# EAGLE board Resistor_Resistor (EAGLE 8.3.0), part 19 of 32
## Placement (x,y rotation side) (continued)
R22977  10K  [0201]  164.34,108.56 0 top
R22978  10K  [0201]  164.34,109.17 0 top
R22979  10K  [0201]  164.34,109.78 0 top
R22980  10K  [0201]  164.34,110.39 0 top
R22981  10K  [0201]  164.34,111 0 top
R22982  10K  [0201]  164.34,111.61 0 top
R22983  10K  [0201]  164.34,112.22 0 top
R22984  10K  [0201]  164.34,112.83 0 top
R22985  10K  [0201]  164.34,113.44 0 top
R22986  10K  [0201]  164.34,114.05 0 top
R22987  10K  [0201]  164.34,114.66 0 top
R22988  10K  [0201]  164.34,115.27 0 top
R22989  10K  [0201]  164.34,115.87 0 top
R22990  10K  [0201]  164.34,116.48 0 top
R22991  10K  [0201]  164.34,117.09 0 top
R22992  10K  [0201]  164.34,117.7 0 top
R22993  10K  [0201]  164.34,118.31 0 top
R22994  10K  [0201]  164.34,118.92 0 top
R22995  10K  [0201]  164.34,119.53 0 top
R22996  10K  [0201]  164.34,120.14 0 top
R22997  10K  [0201]  164.34,120.75 0 top
R22998  10K  [0201]  164.34,121.36 0 top
R22999  10K  [0201]  164.34,121.97 0 top
R23000  10K  [0201]  164.34,122.58 0 top
R23001  10K  [0201]  165.56,1.27 0 top
R23002  10K  [0201]  165.56,1.88 0 top
R23003  10K  [0201]  165.56,2.49 0 top
R23004  10K  [0201]  165.56,3.1 0 top
R23005  10K  [0201]  165.56,3.71 0 top
R23006  10K  [0201]  165.56,4.32 0 top
R23007  10K  [0201]  165.56,4.93 0 top
R23008  10K  [0201]  165.56,5.54 0 top
R23009  10K  [0201]  165.56,6.15 0 top
R23010  10K  [0201]  165.56,6.76 0 top
R23011  10K  [0201]  165.56,7.37 0 top
R23012  10K  [0201]  165.56,7.98 0 top
R23013  10K  [0201]  165.56,8.59 0 top
R23014  10K  [0201]  165.56,9.19 0 top
R23015  10K  [0201]  165.56,9.8 0 top
R23016  10K  [0201]  165.56,10.41 0 top
R23017  10K  [0201]  165.56,11.02 0 top
R23018  10K  [0201]  165.56,11.63 0 top
R23019  10K  [0201]  165.56,12.24 0 top
R23020  10K  [0201]  165.56,12.85 0 top
R23021  10K  [0201]  165.56,13.46 0 top
R23022  10K  [0201]  165.56,14.07 0 top
R23023  10K  [0201]  165.56,14.68 0 top
R23024  10K  [0201]  165.56,15.29 0 top
R23025  10K  [0201]  165.56,15.9 0 top
R23026  10K  [0201]  165.56,16.51 0 top
R23027  10K  [0201]  165.56,17.12 0 top
R23028  10K  [0201]  165.56,17.73 0 top
R23029  10K  [0201]  165.56,18.34 0 top
R23030  10K  [0201]  165.56,18.95 0 top
R23031  10K  [0201]  165.56,19.56 0 top
R23032  10K  [0201]  165.56,20.17 0 top
R23033  10K  [0201]  165.56,20.78 0 top
R23034  10K  [0201]  165.56,21.39 0 top
R23035  10K  [0201]  165.56,22 0 top
R23036  10K  [0201]  165.56,22.61 0 top
R23037  10K  [0201]  165.56,23.22 0 top
R23038  10K  [0201]  165.56,23.83 0 top
R23039  10K  [0201]  165.56,24.43 0 top
R23040  10K  [0201]  165.56,25.04 0 top
R23041  10K  [0201]  165.56,25.65 0 top
R23042  10K  [0201]  165.56,26.26 0 top
R23043  10K  [0201]  165.56,26.87 0 top
R23044  10K  [0201]  165.56,27.48 0 top
R23045  10K  [0201]  165.56,28.09 0 top
R23046  10K  [0201]  165.56,28.7 0 top
R23047  10K  [0201]  165.56,29.31 0 top
R23048  10K  [0201]  165.56,29.92 0 top
R23049  10K  [0201]  165.56,30.53 0 top
R23050  10K  [0201]  165.56,31.14 0 top
R23051  10K  [0201]  165.56,31.75 0 top
R23052  10K  [0201]  165.56,32.36 0 top
R23053  10K  [0201]  165.56,32.97 0 top
R23054  10K  [0201]  165.56,33.58 0 top
R23055  10K  [0201]  165.56,34.19 0 top
R23056  10K  [0201]  165.56,34.8 0 top
R23057  10K  [0201]  165.56,35.41 0 top
R23058  10K  [0201]  165.56,36.02 0 top
R23059  10K  [0201]  165.56,36.63 0 top
R23060  10K  [0201]  165.56,37.24 0 top
R23061  10K  [0201]  165.56,37.85 0 top
R23062  10K  [0201]  165.56,38.46 0 top
R23063  10K  [0201]  165.56,39.07 0 top
R23064  10K  [0201]  165.56,39.67 0 top
R23065  10K  [0201]  165.56,40.28 0 top
R23066  10K  [0201]  165.56,40.89 0 top
R23067  10K  [0201]  165.56,41.5 0 top
R23068  10K  [0201]  165.56,42.11 0 top
R23069  10K  [0201]  165.56,42.72 0 top
R23070  10K  [0201]  165.56,43.33 0 top
R23071  10K  [0201]  165.56,43.94 0 top
R23072  10K  [0201]  165.56,44.55 0 top
R23073  10K  [0201]  165.56,45.16 0 top
R23074  10K  [0201]  165.56,45.77 0 top
R23075  10K  [0201]  165.56,46.38 0 top
R23076  10K  [0201]  165.56,46.99 0 top
R23077  10K  [0201]  165.56,47.6 0 top
R23078  10K  [0201]  165.56,48.21 0 top
R23079  10K  [0201]  165.56,48.82 0 top
R23080  10K  [0201]  165.56,49.43 0 top
R23081  10K  [0201]  165.56,50.04 0 top
R23082  10K  [0201]  165.56,50.65 0 top
R23083  10K  [0201]  165.56,51.26 0 top
R23084  10K  [0201]  165.56,51.87 0 top
R23085  10K  [0201]  165.56,52.48 0 top
R23086  10K  [0201]  165.56,53.09 0 top
R23087  10K  [0201]  165.56,53.7 0 top
R23088  10K  [0201]  165.56,54.31 0 top
R23089  10K  [0201]  165.56,54.91 0 top
R23090  10K  [0201]  165.56,55.52 0 top
R23091  10K  [0201]  165.56,56.13 0 top
R23092  10K  [0201]  165.56,56.74 0 top
R23093  10K  [0201]  165.56,57.35 0 top
R23094  10K  [0201]  165.56,57.96 0 top
R23095  10K  [0201]  165.56,58.57 0 top
R23096  10K  [0201]  165.56,59.18 0 top
R23097  10K  [0201]  165.56,59.79 0 top
R23098  10K  [0201]  165.56,60.4 0 top
R23099  10K  [0201]  165.56,61.01 0 top
R23100  10K  [0201]  165.56,61.62 0 top
R23101  10K  [0201]  165.56,62.23 0 top
R23102  10K  [0201]  165.56,62.84 0 top
R23103  10K  [0201]  165.56,63.45 0 top
R23104  10K  [0201]  165.56,64.06 0 top
R23105  10K  [0201]  165.56,64.67 0 top
R23106  10K  [0201]  165.56,65.28 0 top
R23107  10K  [0201]  165.56,65.89 0 top
R23108  10K  [0201]  165.56,66.5 0 top
R23109  10K  [0201]  165.56,67.11 0 top
R23110  10K  [0201]  165.56,67.72 0 top
R23111  10K  [0201]  165.56,68.33 0 top
R23112  10K  [0201]  165.56,68.94 0 top
R23113  10K  [0201]  165.56,69.55 0 top
R23114  10K  [0201]  165.56,70.15 0 top
R23115  10K  [0201]  165.56,70.76 0 top
R23116  10K  [0201]  165.56,71.37 0 top
R23117  10K  [0201]  165.56,71.98 0 top
R23118  10K  [0201]  165.56,72.59 0 top
R23119  10K  [0201]  165.56,73.2 0 top
R23120  10K  [0201]  165.56,73.81 0 top
R23121  10K  [0201]  165.56,74.42 0 top
R23122  10K  [0201]  165.56,75.03 0 top
R23123  10K  [0201]  165.56,75.64 0 top
R23124  10K  [0201]  165.56,76.25 0 top
R23125  10K  [0201]  165.56,76.86 0 top
R23126  10K  [0201]  165.56,77.47 0 top
R23127  10K  [0201]  165.56,78.08 0 top
R23128  10K  [0201]  165.56,78.69 0 top
R23129  10K  [0201]  165.56,79.3 0 top
R23130  10K  [0201]  165.56,79.91 0 top
R23131  10K  [0201]  165.56,80.52 0 top
R23132  10K  [0201]  165.56,81.13 0 top
R23133  10K  [0201]  165.56,81.74 0 top
R23134  10K  [0201]  165.56,82.35 0 top
R23135  10K  [0201]  165.56,82.96 0 top
R23136  10K  [0201]  165.56,83.57 0 top
R23137  10K  [0201]  165.56,84.18 0 top
R23138  10K  [0201]  165.56,84.79 0 top
R23139  10K  [0201]  165.56,85.39 0 top
R23140  10K  [0201]  165.56,86 0 top
R23141  10K  [0201]  165.56,86.61 0 top
R23142  10K  [0201]  165.56,87.22 0 top
R23143  10K  [0201]  165.56,87.83 0 top
R23144  10K  [0201]  165.56,88.44 0 top
R23145  10K  [0201]  165.56,89.05 0 top
R23146  10K  [0201]  165.56,89.66 0 top
R23147  10K  [0201]  165.56,90.27 0 top
R23148  10K  [0201]  165.56,90.88 0 top
R23149  10K  [0201]  165.56,91.49 0 top
R23150  10K  [0201]  165.56,92.1 0 top
R23151  10K  [0201]  165.56,92.71 0 top
R23152  10K  [0201]  165.56,93.32 0 top
R23153  10K  [0201]  165.56,93.93 0 top
R23154  10K  [0201]  165.56,94.54 0 top
R23155  10K  [0201]  165.56,95.15 0 top
R23156  10K  [0201]  165.56,95.76 0 top
R23157  10K  [0201]  165.56,96.37 0 top
R23158  10K  [0201]  165.56,96.98 0 top
R23159  10K  [0201]  165.56,97.59 0 top
R23160  10K  [0201]  165.56,98.2 0 top
R23161  10K  [0201]  165.56,98.81 0 top
R23162  10K  [0201]  165.56,99.42 0 top
R23163  10K  [0201]  165.56,100.03 0 top
R23164  10K  [0201]  165.56,100.63 0 top
R23165  10K  [0201]  165.56,101.24 0 top
R23166  10K  [0201]  165.56,101.85 0 top
R23167  10K  [0201]  165.56,102.46 0 top
R23168  10K  [0201]  165.56,103.07 0 top
R23169  10K  [0201]  165.56,103.68 0 top
R23170  10K  [0201]  165.56,104.29 0 top
R23171  10K  [0201]  165.56,104.9 0 top
R23172  10K  [0201]  165.56,105.51 0 top
R23173  10K  [0201]  165.56,106.12 0 top
R23174  10K  [0201]  165.56,106.73 0 top
R23175  10K  [0201]  165.56,107.34 0 top
R23176  10K  [0201]  165.56,107.95 0 top
R23177  10K  [0201]  165.56,108.56 0 top
R23178  10K  [0201]  165.56,109.17 0 top
R23179  10K  [0201]  165.56,109.78 0 top
R23180  10K  [0201]  165.56,110.39 0 top
R23181  10K  [0201]  165.56,111 0 top
R23182  10K  [0201]  165.56,111.61 0 top
R23183  10K  [0201]  165.56,112.22 0 top
R23184  10K  [0201]  165.56,112.83 0 top
R23185  10K  [0201]  165.56,113.44 0 top
R23186  10K  [0201]  165.56,114.05 0 top
R23187  10K  [0201]  165.56,114.66 0 top
R23188  10K  [0201]  165.56,115.27 0 top
R23189  10K  [0201]  165.56,115.87 0 top
R23190  10K  [0201]  165.56,116.48 0 top
R23191  10K  [0201]  165.56,117.09 0 top
R23192  10K  [0201]  165.56,117.7 0 top
R23193  10K  [0201]  165.56,118.31 0 top
R23194  10K  [0201]  165.56,118.92 0 top
R23195  10K  [0201]  165.56,119.53 0 top
R23196  10K  [0201]  165.56,120.14 0 top
R23197  10K  [0201]  165.56,120.75 0 top
R23198  10K  [0201]  165.56,121.36 0 top
R23199  10K  [0201]  165.56,121.97 0 top
R23200  10K  [0201]  165.56,122.58 0 top
R23201  10K  [0201]  166.78,1.27 0 top
R23202  10K  [0201]  166.78,1.88 0 top
R23203  10K  [0201]  166.78,2.49 0 top
R23204  10K  [0201]  166.78,3.1 0 top
R23205  10K  [0201]  166.78,3.71 0 top
R23206  10K  [0201]  166.78,4.32 0 top
R23207  10K  [0201]  166.78,4.93 0 top
R23208  10K  [0201]  166.78,5.54 0 top
R23209  10K  [0201]  166.78,6.15 0 top
R23210  10K  [0201]  166.78,6.76 0 top
R23211  10K  [0201]  166.78,7.37 0 top
R23212  10K  [0201]  166.78,7.98 0 top
R23213  10K  [0201]  166.78,8.59 0 top
R23214  10K  [0201]  166.78,9.19 0 top
R23215  10K  [0201]  166.78,9.8 0 top
R23216  10K  [0201]  166.78,10.41 0 top
R23217  10K  [0201]  166.78,11.02 0 top
R23218  10K  [0201]  166.78,11.63 0 top
R23219  10K  [0201]  166.78,12.24 0 top
R23220  10K  [0201]  166.78,12.85 0 top
R23221  10K  [0201]  166.78,13.46 0 top
R23222  10K  [0201]  166.78,14.07 0 top
R23223  10K  [0201]  166.78,14.68 0 top
R23224  10K  [0201]  166.78,15.29 0 top
R23225  10K  [0201]  166.78,15.9 0 top
R23226  10K  [0201]  166.78,16.51 0 top
R23227  10K  [0201]  166.78,17.12 0 top
R23228  10K  [0201]  166.78,17.73 0 top
R23229  10K  [0201]  166.78,18.34 0 top
R23230  10K  [0201]  166.78,18.95 0 top
R23231  10K  [0201]  166.78,19.56 0 top
R23232  10K  [0201]  166.78,20.17 0 top
R23233  10K  [0201]  166.78,20.78 0 top
R23234  10K  [0201]  166.78,21.39 0 top
R23235  10K  [0201]  166.78,22 0 top
R23236  10K  [0201]  166.78,22.61 0 top
R23237  10K  [0201]  166.78,23.22 0 top
R23238  10K  [0201]  166.78,23.83 0 top
R23239  10K  [0201]  166.78,24.43 0 top
R23240  10K  [0201]  166.78,25.04 0 top
R23241  10K  [0201]  166.78,25.65 0 top
R23242  10K  [0201]  166.78,26.26 0 top
R23243  10K  [0201]  166.78,26.87 0 top
R23244  10K  [0201]  166.78,27.48 0 top
R23245  10K  [0201]  166.78,28.09 0 top
R23246  10K  [0201]  166.78,28.7 0 top
R23247  10K  [0201]  166.78,29.31 0 top
R23248  10K  [0201]  166.78,29.92 0 top
R23249  10K  [0201]  166.78,30.53 0 top
R23250  10K  [0201]  166.78,31.14 0 top
R23251  10K  [0201]  166.78,31.75 0 top
R23252  10K  [0201]  166.78,32.36 0 top
R23253  10K  [0201]  166.78,32.97 0 top
R23254  10K  [0201]  166.78,33.58 0 top
R23255  10K  [0201]  166.78,34.19 0 top
R23256  10K  [0201]  166.78,34.8 0 top
R23257  10K  [0201]  166.78,35.41 0 top
R23258  10K  [0201]  166.78,36.02 0 top
R23259  10K  [0201]  166.78,36.63 0 top
R23260  10K  [0201]  166.78,37.24 0 top
R23261  10K  [0201]  166.78,37.85 0 top
R23262  10K  [0201]  166.78,38.46 0 top
R23263  10K  [0201]  166.78,39.07 0 top
R23264  10K  [0201]  166.78,39.67 0 top
R23265  10K  [0201]  166.78,40.28 0 top
R23266  10K  [0201]  166.78,40.89 0 top
R23267  10K  [0201]  166.78,41.5 0 top
R23268  10K  [0201]  166.78,42.11 0 top
R23269  10K  [0201]  166.78,42.72 0 top
R23270  10K  [0201]  166.78,43.33 0 top
R23271  10K  [0201]  166.78,43.94 0 top
R23272  10K  [0201]  166.78,44.55 0 top
R23273  10K  [0201]  166.78,45.16 0 top
R23274  10K  [0201]  166.78,45.77 0 top
R23275  10K  [0201]  166.78,46.38 0 top
R23276  10K  [0201]  166.78,46.99 0 top
R23277  10K  [0201]  166.78,47.6 0 top
R23278  10K  [0201]  166.78,48.21 0 top
R23279  10K  [0201]  166.78,48.82 0 top
R23280  10K  [0201]  166.78,49.43 0 top
R23281  10K  [0201]  166.78,50.04 0 top
R23282  10K  [0201]  166.78,50.65 0 top
R23283  10K  [0201]  166.78,51.26 0 top
R23284  10K  [0201]  166.78,51.87 0 top
R23285  10K  [0201]  166.78,52.48 0 top
R23286  10K  [0201]  166.78,53.09 0 top
R23287  10K  [0201]  166.78,53.7 0 top
R23288  10K  [0201]  166.78,54.31 0 top
R23289  10K  [0201]  166.78,54.91 0 top
R23290  10K  [0201]  166.78,55.52 0 top
R23291  10K  [0201]  166.78,56.13 0 top
R23292  10K  [0201]  166.78,56.74 0 top
R23293  10K  [0201]  166.78,57.35 0 top
R23294  10K  [0201]  166.78,57.96 0 top
R23295  10K  [0201]  166.78,58.57 0 top
R23296  10K  [0201]  166.78,59.18 0 top
R23297  10K  [0201]  166.78,59.79 0 top
R23298  10K  [0201]  166.78,60.4 0 top
R23299  10K  [0201]  166.78,61.01 0 top
R23300  10K  [0201]  166.78,61.62 0 top
R23301  10K  [0201]  166.78,62.23 0 top
R23302  10K  [0201]  166.78,62.84 0 top
R23303  10K  [0201]  166.78,63.45 0 top
R23304  10K  [0201]  166.78,64.06 0 top
R23305  10K  [0201]  166.78,64.67 0 top
R23306  10K  [0201]  166.78,65.28 0 top
R23307  10K  [0201]  166.78,65.89 0 top
R23308  10K  [0201]  166.78,66.5 0 top
R23309  10K  [0201]  166.78,67.11 0 top
R23310  10K  [0201]  166.78,67.72 0 top
R23311  10K  [0201]  166.78,68.33 0 top
R23312  10K  [0201]  166.78,68.94 0 top
R23313  10K  [0201]  166.78,69.55 0 top
R23314  10K  [0201]  166.78,70.15 0 top
R23315  10K  [0201]  166.78,70.76 0 top
R23316  10K  [0201]  166.78,71.37 0 top
R23317  10K  [0201]  166.78,71.98 0 top
R23318  10K  [0201]  166.78,72.59 0 top
R23319  10K  [0201]  166.78,73.2 0 top
R23320  10K  [0201]  166.78,73.81 0 top
R23321  10K  [0201]  166.78,74.42 0 top
R23322  10K  [0201]  166.78,75.03 0 top
R23323  10K  [0201]  166.78,75.64 0 top
R23324  10K  [0201]  166.78,76.25 0 top
R23325  10K  [0201]  166.78,76.86 0 top
R23326  10K  [0201]  166.78,77.47 0 top
R23327  10K  [0201]  166.78,78.08 0 top
R23328  10K  [0201]  166.78,78.69 0 top
R23329  10K  [0201]  166.78,79.3 0 top
R23330  10K  [0201]  166.78,79.91 0 top
R23331  10K  [0201]  166.78,80.52 0 top
R23332  10K  [0201]  166.78,81.13 0 top
R23333  10K  [0201]  166.78,81.74 0 top
R23334  10K  [0201]  166.78,82.35 0 top
R23335  10K  [0201]  166.78,82.96 0 top
R23336  10K  [0201]  166.78,83.57 0 top
R23337  10K  [0201]  166.78,84.18 0 top
R23338  10K  [0201]  166.78,84.79 0 top
R23339  10K  [0201]  166.78,85.39 0 top
R23340  10K  [0201]  166.78,86 0 top
R23341  10K  [0201]  166.78,86.61 0 top
R23342  10K  [0201]  166.78,87.22 0 top
R23343  10K  [0201]  166.78,87.83 0 top
R23344  10K  [0201]  166.78,88.44 0 top
R23345  10K  [0201]  166.78,89.05 0 top
R23346  10K  [0201]  166.78,89.66 0 top
R23347  10K  [0201]  166.78,90.27 0 top
R23348  10K  [0201]  166.78,90.88 0 top
R23349  10K  [0201]  166.78,91.49 0 top
R23350  10K  [0201]  166.78,92.1 0 top
R23351  10K  [0201]  166.78,92.71 0 top
R23352  10K  [0201]  166.78,93.32 0 top
R23353  10K  [0201]  166.78,93.93 0 top
R23354  10K  [0201]  166.78,94.54 0 top
R23355  10K  [0201]  166.78,95.15 0 top
R23356  10K  [0201]  166.78,95.76 0 top
R23357  10K  [0201]  166.78,96.37 0 top
R23358  10K  [0201]  166.78,96.98 0 top
R23359  10K  [0201]  166.78,97.59 0 top
R23360  10K  [0201]  166.78,98.2 0 top
R23361  10K  [0201]  166.78,98.81 0 top
R23362  10K  [0201]  166.78,99.42 0 top
R23363  10K  [0201]  166.78,100.03 0 top
R23364  10K  [0201]  166.78,100.63 0 top
R23365  10K  [0201]  166.78,101.24 0 top
R23366  10K  [0201]  166.78,101.85 0 top
R23367  10K  [0201]  166.78,102.46 0 top
R23368  10K  [0201]  166.78,103.07 0 top
R23369  10K  [0201]  166.78,103.68 0 top
R23370  10K  [0201]  166.78,104.29 0 top
R23371  10K  [0201]  166.78,104.9 0 top
R23372  10K  [0201]  166.78,105.51 0 top
R23373  10K  [0201]  166.78,106.12 0 top
R23374  10K  [0201]  166.78,106.73 0 top
R23375  10K  [0201]  166.78,107.34 0 top
R23376  10K  [0201]  166.78,107.95 0 top
R23377  10K  [0201]  166.78,108.56 0 top
R23378  10K  [0201]  166.78,109.17 0 top
R23379  10K  [0201]  166.78,109.78 0 top
R23380  10K  [0201]  166.78,110.39 0 top
R23381  10K  [0201]  166.78,111 0 top
R23382  10K  [0201]  166.78,111.61 0 top
R23383  10K  [0201]  166.78,112.22 0 top
R23384  10K  [0201]  166.78,112.83 0 top
R23385  10K  [0201]  166.78,113.44 0 top
R23386  10K  [0201]  166.78,114.05 0 top
R23387  10K  [0201]  166.78,114.66 0 top
R23388  10K  [0201]  166.78,115.27 0 top
R23389  10K  [0201]  166.78,115.87 0 top
R23390  10K  [0201]  166.78,116.48 0 top
R23391  10K  [0201]  166.78,117.09 0 top
R23392  10K  [0201]  166.78,117.7 0 top
R23393  10K  [0201]  166.78,118.31 0 top
R23394  10K  [0201]  166.78,118.92 0 top
R23395  10K  [0201]  166.78,119.53 0 top
R23396  10K  [0201]  166.78,120.14 0 top
R23397  10K  [0201]  166.78,120.75 0 top
R23398  10K  [0201]  166.78,121.36 0 top
R23399  10K  [0201]  166.78,121.97 0 top
R23400  10K  [0201]  166.78,122.58 0 top
R23401  10K  [0201]  168,1.27 0 top
R23402  10K  [0201]  168,1.88 0 top
R23403  10K  [0201]  168,2.49 0 top
R23404  10K  [0201]  168,3.1 0 top
R23405  10K  [0201]  168,3.71 0 top
R23406  10K  [0201]  168,4.32 0 top
R23407  10K  [0201]  168,4.93 0 top
R23408  10K  [0201]  168,5.54 0 top
R23409  10K  [0201]  168,6.15 0 top
R23410  10K  [0201]  168,6.76 0 top
R23411  10K  [0201]  168,7.37 0 top
R23412  10K  [0201]  168,7.98 0 top
R23413  10K  [0201]  168,8.59 0 top
R23414  10K  [0201]  168,9.19 0 top
R23415  10K  [0201]  168,9.8 0 top
R23416  10K  [0201]  168,10.41 0 top
R23417  10K  [0201]  168,11.02 0 top
R23418  10K  [0201]  168,11.63 0 top
R23419  10K  [0201]  168,12.24 0 top
R23420  10K  [0201]  168,12.85 0 top
R23421  10K  [0201]  168,13.46 0 top
R23422  10K  [0201]  168,14.07 0 top
R23423  10K  [0201]  168,14.68 0 top
R23424  10K  [0201]  168,15.29 0 top
R23425  10K  [0201]  168,15.9 0 top
R23426  10K  [0201]  168,16.51 0 top
R23427  10K  [0201]  168,17.12 0 top
R23428  10K  [0201]  168,17.73 0 top
R23429  10K  [0201]  168,18.34 0 top
R23430  10K  [0201]  168,18.95 0 top
R23431  10K  [0201]  168,19.56 0 top
R23432  10K  [0201]  168,20.17 0 top
R23433  10K  [0201]  168,20.78 0 top
R23434  10K  [0201]  168,21.39 0 top
R23435  10K  [0201]  168,22 0 top
R23436  10K  [0201]  168,22.61 0 top
R23437  10K  [0201]  168,23.22 0 top
R23438  10K  [0201]  168,23.83 0 top
R23439  10K  [0201]  168,24.43 0 top
R23440  10K  [0201]  168,25.04 0 top
R23441  10K  [0201]  168,25.65 0 top
R23442  10K  [0201]  168,26.26 0 top
R23443  10K  [0201]  168,26.87 0 top
R23444  10K  [0201]  168,27.48 0 top
R23445  10K  [0201]  168,28.09 0 top
R23446  10K  [0201]  168,28.7 0 top
R23447  10K  [0201]  168,29.31 0 top
R23448  10K  [0201]  168,29.92 0 top
R23449  10K  [0201]  168,30.53 0 top
R23450  10K  [0201]  168,31.14 0 top
R23451  10K  [0201]  168,31.75 0 top
R23452  10K  [0201]  168,32.36 0 top
R23453  10K  [0201]  168,32.97 0 top
R23454  10K  [0201]  168,33.58 0 top
R23455  10K  [0201]  168,34.19 0 top
R23456  10K  [0201]  168,34.8 0 top
R23457  10K  [0201]  168,35.41 0 top
R23458  10K  [0201]  168,36.02 0 top
R23459  10K  [0201]  168,36.63 0 top
R23460  10K  [0201]  168,37.24 0 top
R23461  10K  [0201]  168,37.85 0 top
R23462  10K  [0201]  168,38.46 0 top
R23463  10K  [0201]  168,39.07 0 top
R23464  10K  [0201]  168,39.67 0 top
R23465  10K  [0201]  168,40.28 0 top
R23466  10K  [0201]  168,40.89 0 top
R23467  10K  [0201]  168,41.5 0 top
R23468  10K  [0201]  168,42.11 0 top
R23469  10K  [0201]  168,42.72 0 top
R23470  10K  [0201]  168,43.33 0 top
R23471  10K  [0201]  168,43.94 0 top
R23472  10K  [0201]  168,44.55 0 top
R23473  10K  [0201]  168,45.16 0 top
R23474  10K  [0201]  168,45.77 0 top
R23475  10K  [0201]  168,46.38 0 top
R23476  10K  [0201]  168,46.99 0 top
R23477  10K  [0201]  168,47.6 0 top
R23478  10K  [0201]  168,48.21 0 top
R23479  10K  [0201]  168,48.82 0 top
R23480  10K  [0201]  168,49.43 0 top
R23481  10K  [0201]  168,50.04 0 top
R23482  10K  [0201]  168,50.65 0 top
R23483  10K  [0201]  168,51.26 0 top
R23484  10K  [0201]  168,51.87 0 top
R23485  10K  [0201]  168,52.48 0 top
R23486  10K  [0201]  168,53.09 0 top
R23487  10K  [0201]  168,53.7 0 top
R23488  10K  [0201]  168,54.31 0 top
R23489  10K  [0201]  168,54.91 0 top
R23490  10K  [0201]  168,55.52 0 top
R23491  10K  [0201]  168,56.13 0 top
R23492  10K  [0201]  168,56.74 0 top
R23493  10K  [0201]  168,57.35 0 top
R23494  10K  [0201]  168,57.96 0 top
R23495  10K  [0201]  168,58.57 0 top
R23496  10K  [0201]  168,59.18 0 top
R23497  10K  [0201]  168,59.79 0 top
R23498  10K  [0201]  168,60.4 0 top
R23499  10K  [0201]  168,61.01 0 top
R23500  10K  [0201]  168,61.62 0 top
R23501  10K  [0201]  168,62.23 0 top
R23502  10K  [0201]  168,62.84 0 top
R23503  10K  [0201]  168,63.45 0 top
R23504  10K  [0201]  168,64.06 0 top
R23505  10K  [0201]  168,64.67 0 top
R23506  10K  [0201]  168,65.28 0 top
R23507  10K  [0201]  168,65.89 0 top
R23508  10K  [0201]  168,66.5 0 top
R23509  10K  [0201]  168,67.11 0 top
R23510  10K  [0201]  168,67.72 0 top
R23511  10K  [0201]  168,68.33 0 top
R23512  10K  [0201]  168,68.94 0 top
R23513  10K  [0201]  168,69.55 0 top
R23514  10K  [0201]  168,70.15 0 top
R23515  10K  [0201]  168,70.76 0 top
R23516  10K  [0201]  168,71.37 0 top
R23517  10K  [0201]  168,71.98 0 top
R23518  10K  [0201]  168,72.59 0 top
R23519  10K  [0201]  168,73.2 0 top
R23520  10K  [0201]  168,73.81 0 top
R23521  10K  [0201]  168,74.42 0 top
R23522  10K  [0201]  168,75.03 0 top
R23523  10K  [0201]  168,75.64 0 top
R23524  10K  [0201]  168,76.25 0 top
R23525  10K  [0201]  168,76.86 0 top
R23526  10K  [0201]  168,77.47 0 top
R23527  10K  [0201]  168,78.08 0 top
R23528  10K  [0201]  168,78.69 0 top
R23529  10K  [0201]  168,79.3 0 top
R23530  10K  [0201]  168,79.91 0 top
R23531  10K  [0201]  168,80.52 0 top
R23532  10K  [0201]  168,81.13 0 top
R23533  10K  [0201]  168,81.74 0 top
R23534  10K  [0201]  168,82.35 0 top
R23535  10K  [0201]  168,82.96 0 top
R23536  10K  [0201]  168,83.57 0 top
R23537  10K  [0201]  168,84.18 0 top
R23538  10K  [0201]  168,84.79 0 top
R23539  10K  [0201]  168,85.39 0 top
R23540  10K  [0201]  168,86 0 top
R23541  10K  [0201]  168,86.61 0 top
R23542  10K  [0201]  168,87.22 0 top
R23543  10K  [0201]  168,87.83 0 top
R23544  10K  [0201]  168,88.44 0 top
R23545  10K  [0201]  168,89.05 0 top
R23546  10K  [0201]  168,89.66 0 top
R23547  10K  [0201]  168,90.27 0 top
R23548  10K  [0201]  168,90.88 0 top
R23549  10K  [0201]  168,91.49 0 top
R23550  10K  [0201]  168,92.1 0 top
R23551  10K  [0201]  168,92.71 0 top
R23552  10K  [0201]  168,93.32 0 top
R23553  10K  [0201]  168,93.93 0 top
R23554  10K  [0201]  168,94.54 0 top
R23555  10K  [0201]  168,95.15 0 top
R23556  10K  [0201]  168,95.76 0 top
R23557  10K  [0201]  168,96.37 0 top
R23558  10K  [0201]  168,96.98 0 top
R23559  10K  [0201]  168,97.59 0 top
R23560  10K  [0201]  168,98.2 0 top
R23561  10K  [0201]  168,98.81 0 top
R23562  10K  [0201]  168,99.42 0 top
R23563  10K  [0201]  168,100.03 0 top
R23564  10K  [0201]  168,100.63 0 top
R23565  10K  [0201]  168,101.24 0 top
R23566  10K  [0201]  168,101.85 0 top
R23567  10K  [0201]  168,102.46 0 top
R23568  10K  [0201]  168,103.07 0 top
R23569  10K  [0201]  168,103.68 0 top
R23570  10K  [0201]  168,104.29 0 top
R23571  10K  [0201]  168,104.9 0 top
R23572  10K  [0201]  168,105.51 0 top
R23573  10K  [0201]  168,106.12 0 top
R23574  10K  [0201]  168,106.73 0 top
R23575  10K  [0201]  168,107.34 0 top
R23576  10K  [0201]  168,107.95 0 top
R23577  10K  [0201]  168,108.56 0 top
R23578  10K  [0201]  168,109.17 0 top
R23579  10K  [0201]  168,109.78 0 top
R23580  10K  [0201]  168,110.39 0 top
R23581  10K  [0201]  168,111 0 top
R23582  10K  [0201]  168,111.61 0 top
R23583  10K  [0201]  168,112.22 0 top
R23584  10K  [0201]  168,112.83 0 top
R23585  10K  [0201]  168,113.44 0 top
R23586  10K  [0201]  168,114.05 0 top
R23587  10K  [0201]  168,114.66 0 top
R23588  10K  [0201]  168,115.27 0 top
R23589  10K  [0201]  168,115.87 0 top
R23590  10K  [0201]  168,116.48 0 top
R23591  10K  [0201]  168,117.09 0 top
R23592  10K  [0201]  168,117.7 0 top
R23593  10K  [0201]  168,118.31 0 top
R23594  10K  [0201]  168,118.92 0 top
R23595  10K  [0201]  168,119.53 0 top
R23596  10K  [0201]  168,120.14 0 top
R23597  10K  [0201]  168,120.75 0 top
R23598  10K  [0201]  168,121.36 0 top
R23599  10K  [0201]  168,121.97 0 top
R23600  10K  [0201]  168,122.58 0 top
R23601  10K  [0201]  169.21,1.27 0 top
R23602  10K  [0201]  169.21,1.88 0 top
R23603  10K  [0201]  169.21,2.49 0 top
R23604  10K  [0201]  169.21,3.1 0 top
R23605  10K  [0201]  169.21,3.71 0 top
R23606  10K  [0201]  169.21,4.32 0 top
R23607  10K  [0201]  169.21,4.93 0 top
R23608  10K  [0201]  169.21,5.54 0 top
R23609  10K  [0201]  169.21,6.15 0 top
R23610  10K  [0201]  169.21,6.76 0 top
R23611  10K  [0201]  169.21,7.37 0 top
R23612  10K  [0201]  169.21,7.98 0 top
R23613  10K  [0201]  169.21,8.59 0 top
R23614  10K  [0201]  169.21,9.19 0 top
R23615  10K  [0201]  169.21,9.8 0 top
R23616  10K  [0201]  169.21,10.41 0 top
R23617  10K  [0201]  169.21,11.02 0 top
R23618  10K  [0201]  169.21,11.63 0 top
R23619  10K  [0201]  169.21,12.24 0 top
R23620  10K  [0201]  169.21,12.85 0 top
R23621  10K  [0201]  169.21,13.46 0 top
R23622  10K  [0201]  169.21,14.07 0 top
R23623  10K  [0201]  169.21,14.68 0 top
R23624  10K  [0201]  169.21,15.29 0 top
R23625  10K  [0201]  169.21,15.9 0 top
R23626  10K  [0201]  169.21,16.51 0 top
R23627  10K  [0201]  169.21,17.12 0 top
R23628  10K  [0201]  169.21,17.73 0 top
R23629  10K  [0201]  169.21,18.34 0 top
R23630  10K  [0201]  169.21,18.95 0 top
R23631  10K  [0201]  169.21,19.56 0 top
R23632  10K  [0201]  169.21,20.17 0 top
R23633  10K  [0201]  169.21,20.78 0 top
R23634  10K  [0201]  169.21,21.39 0 top
R23635  10K  [0201]  169.21,22 0 top
R23636  10K  [0201]  169.21,22.61 0 top
R23637  10K  [0201]  169.21,23.22 0 top
R23638  10K  [0201]  169.21,23.83 0 top
R23639  10K  [0201]  169.21,24.43 0 top
R23640  10K  [0201]  169.21,25.04 0 top
R23641  10K  [0201]  169.21,25.65 0 top
R23642  10K  [0201]  169.21,26.26 0 top
R23643  10K  [0201]  169.21,26.87 0 top
R23644  10K  [0201]  169.21,27.48 0 top
R23645  10K  [0201]  169.21,28.09 0 top
R23646  10K  [0201]  169.21,28.7 0 top
R23647  10K  [0201]  169.21,29.31 0 top
R23648  10K  [0201]  169.21,29.92 0 top
R23649  10K  [0201]  169.21,30.53 0 top
R23650  10K  [0201]  169.21,31.14 0 top
R23651  10K  [0201]  169.21,31.75 0 top
R23652  10K  [0201]  169.21,32.36 0 top
R23653  10K  [0201]  169.21,32.97 0 top
R23654  10K  [0201]  169.21,33.58 0 top
R23655  10K  [0201]  169.21,34.19 0 top
R23656  10K  [0201]  169.21,34.8 0 top
R23657  10K  [0201]  169.21,35.41 0 top
R23658  10K  [0201]  169.21,36.02 0 top
R23659  10K  [0201]  169.21,36.63 0 top
R23660  10K  [0201]  169.21,37.24 0 top
R23661  10K  [0201]  169.21,37.85 0 top
R23662  10K  [0201]  169.21,38.46 0 top
R23663  10K  [0201]  169.21,39.07 0 top
R23664  10K  [0201]  169.21,39.67 0 top
R23665  10K  [0201]  169.21,40.28 0 top
R23666  10K  [0201]  169.21,40.89 0 top
R23667  10K  [0201]  169.21,41.5 0 top
R23668  10K  [0201]  169.21,42.11 0 top
R23669  10K  [0201]  169.21,42.72 0 top
R23670  10K  [0201]  169.21,43.33 0 top
R23671  10K  [0201]  169.21,43.94 0 top
R23672  10K  [0201]  169.21,44.55 0 top
R23673  10K  [0201]  169.21,45.16 0 top
R23674  10K  [0201]  169.21,45.77 0 top
R23675  10K  [0201]  169.21,46.38 0 top
R23676  10K  [0201]  169.21,46.99 0 top
R23677  10K  [0201]  169.21,47.6 0 top
R23678  10K  [0201]  169.21,48.21 0 top
R23679  10K  [0201]  169.21,48.82 0 top
R23680  10K  [0201]  169.21,49.43 0 top
R23681  10K  [0201]  169.21,50.04 0 top
R23682  10K  [0201]  169.21,50.65 0 top
R23683  10K  [0201]  169.21,51.26 0 top
R23684  10K  [0201]  169.21,51.87 0 top
R23685  10K  [0201]  169.21,52.48 0 top
R23686  10K  [0201]  169.21,53.09 0 top
R23687  10K  [0201]  169.21,53.7 0 top
R23688  10K  [0201]  169.21,54.31 0 top
R23689  10K  [0201]  169.21,54.91 0 top
R23690  10K  [0201]  169.21,55.52 0 top
R23691  10K  [0201]  169.21,56.13 0 top
R23692  10K  [0201]  169.21,56.74 0 top
R23693  10K  [0201]  169.21,57.35 0 top
R23694  10K  [0201]  169.21,57.96 0 top
R23695  10K  [0201]  169.21,58.57 0 top
R23696  10K  [0201]  169.21,59.18 0 top
R23697  10K  [0201]  169.21,59.79 0 top
R23698  10K  [0201]  169.21,60.4 0 top
R23699  10K  [0201]  169.21,61.01 0 top
R23700  10K  [0201]  169.21,61.62 0 top
R23701  10K  [0201]  169.21,62.23 0 top
R23702  10K  [0201]  169.21,62.84 0 top
R23703  10K  [0201]  169.21,63.45 0 top
R23704  10K  [0201]  169.21,64.06 0 top
R23705  10K  [0201]  169.21,64.67 0 top
R23706  10K  [0201]  169.21,65.28 0 top
R23707  10K  [0201]  169.21,65.89 0 top
R23708  10K  [0201]  169.21,66.5 0 top
R23709  10K  [0201]  169.21,67.11 0 top
R23710  10K  [0201]  169.21,67.72 0 top
R23711  10K  [0201]  169.21,68.33 0 top
R23712  10K  [0201]  169.21,68.94 0 top
R23713  10K  [0201]  169.21,69.55 0 top
R23714  10K  [0201]  169.21,70.15 0 top
R23715  10K  [0201]  169.21,70.76 0 top
R23716  10K  [0201]  169.21,71.37 0 top
R23717  10K  [0201]  169.21,71.98 0 top
R23718  10K  [0201]  169.21,72.59 0 top
R23719  10K  [0201]  169.21,73.2 0 top
R23720  10K  [0201]  169.21,73.81 0 top
R23721  10K  [0201]  169.21,74.42 0 top
R23722  10K  [0201]  169.21,75.03 0 top
R23723  10K  [0201]  169.21,75.64 0 top
R23724  10K  [0201]  169.21,76.25 0 top
R23725  10K  [0201]  169.21,76.86 0 top
R23726  10K  [0201]  169.21,77.47 0 top
R23727  10K  [0201]  169.21,78.08 0 top
R23728  10K  [0201]  169.21,78.69 0 top
R23729  10K  [0201]  169.21,79.3 0 top
R23730  10K  [0201]  169.21,79.91 0 top
R23731  10K  [0201]  169.21,80.52 0 top
R23732  10K  [0201]  169.21,81.13 0 top
R23733  10K  [0201]  169.21,81.74 0 top
R23734  10K  [0201]  169.21,82.35 0 top
R23735  10K  [0201]  169.21,82.96 0 top
R23736  10K  [0201]  169.21,83.57 0 top
R23737  10K  [0201]  169.21,84.18 0 top
R23738  10K  [0201]  169.21,84.79 0 top
R23739  10K  [0201]  169.21,85.39 0 top
R23740  10K  [0201]  169.21,86 0 top
R23741  10K  [0201]  169.21,86.61 0 top
R23742  10K  [0201]  169.21,87.22 0 top
R23743  10K  [0201]  169.21,87.83 0 top
R23744  10K  [0201]  169.21,88.44 0 top
R23745  10K  [0201]  169.21,89.05 0 top
R23746  10K  [0201]  169.21,89.66 0 top
R23747  10K  [0201]  169.21,90.27 0 top
R23748  10K  [0201]  169.21,90.88 0 top
R23749  10K  [0201]  169.21,91.49 0 top
R23750  10K  [0201]  169.21,92.1 0 top
R23751  10K  [0201]  169.21,92.71 0 top
R23752  10K  [0201]  169.21,93.32 0 top
R23753  10K  [0201]  169.21,93.93 0 top
R23754  10K  [0201]  169.21,94.54 0 top
R23755  10K  [0201]  169.21,95.15 0 top
R23756  10K  [0201]  169.21,95.76 0 top
R23757  10K  [0201]  169.21,96.37 0 top
R23758  10K  [0201]  169.21,96.98 0 top
R23759  10K  [0201]  169.21,97.59 0 top
R23760  10K  [0201]  169.21,98.2 0 top
R23761  10K  [0201]  169.21,98.81 0 top
R23762  10K  [0201]  169.21,99.42 0 top
R23763  10K  [0201]  169.21,100.03 0 top
R23764  10K  [0201]  169.21,100.63 0 top
R23765  10K  [0201]  169.21,101.24 0 top
R23766  10K  [0201]  169.21,101.85 0 top
R23767  10K  [0201]  169.21,102.46 0 top
R23768  10K  [0201]  169.21,103.07 0 top
R23769  10K  [0201]  169.21,103.68 0 top
R23770  10K  [0201]  169.21,104.29 0 top
R23771  10K  [0201]  169.21,104.9 0 top
R23772  10K  [0201]  169.21,105.51 0 top
R23773  10K  [0201]  169.21,106.12 0 top
R23774  10K  [0201]  169.21,106.73 0 top
R23775  10K  [0201]  169.21,107.34 0 top
R23776  10K  [0201]  169.21,107.95 0 top
R23777  10K  [0201]  169.21,108.56 0 top
R23778  10K  [0201]  169.21,109.17 0 top
R23779  10K  [0201]  169.21,109.78 0 top
R23780  10K  [0201]  169.21,110.39 0 top
R23781  10K  [0201]  169.21,111 0 top
R23782  10K  [0201]  169.21,111.61 0 top
R23783  10K  [0201]  169.21,112.22 0 top
R23784  10K  [0201]  169.21,112.83 0 top
R23785  10K  [0201]  169.21,113.44 0 top
R23786  10K  [0201]  169.21,114.05 0 top
R23787  10K  [0201]  169.21,114.66 0 top
R23788  10K  [0201]  169.21,115.27 0 top
R23789  10K  [0201]  169.21,115.87 0 top
R23790  10K  [0201]  169.21,116.48 0 top
R23791  10K  [0201]  169.21,117.09 0 top
R23792  10K  [0201]  169.21,117.7 0 top
R23793  10K  [0201]  169.21,118.31 0 top
R23794  10K  [0201]  169.21,118.92 0 top
R23795  10K  [0201]  169.21,119.53 0 top
R23796  10K  [0201]  169.21,120.14 0 top
R23797  10K  [0201]  169.21,120.75 0 top
R23798  10K  [0201]  169.21,121.36 0 top
R23799  10K  [0201]  169.21,121.97 0 top
R23800  10K  [0201]  169.21,122.58 0 top
R23801  10K  [0201]  170.43,1.27 0 top
R23802  10K  [0201]  170.43,1.88 0 top
R23803  10K  [0201]  170.43,2.49 0 top
R23804  10K  [0201]  170.43,3.1 0 top
R23805  10K  [0201]  170.43,3.71 0 top
R23806  10K  [0201]  170.43,4.32 0 top
R23807  10K  [0201]  170.43,4.93 0 top
R23808  10K  [0201]  170.43,5.54 0 top
R23809  10K  [0201]  170.43,6.15 0 top
R23810  10K  [0201]  170.43,6.76 0 top
R23811  10K  [0201]  170.43,7.37 0 top
R23812  10K  [0201]  170.43,7.98 0 top
R23813  10K  [0201]  170.43,8.59 0 top
R23814  10K  [0201]  170.43,9.19 0 top
R23815  10K  [0201]  170.43,9.8 0 top
R23816  10K  [0201]  170.43,10.41 0 top
R23817  10K  [0201]  170.43,11.02 0 top
R23818  10K  [0201]  170.43,11.63 0 top
R23819  10K  [0201]  170.43,12.24 0 top
R23820  10K  [0201]  170.43,12.85 0 top
R23821  10K  [0201]  170.43,13.46 0 top
R23822  10K  [0201]  170.43,14.07 0 top
R23823  10K  [0201]  170.43,14.68 0 top
R23824  10K  [0201]  170.43,15.29 0 top
R23825  10K  [0201]  170.43,15.9 0 top
R23826  10K  [0201]  170.43,16.51 0 top
R23827  10K  [0201]  170.43,17.12 0 top
R23828  10K  [0201]  170.43,17.73 0 top
R23829  10K  [0201]  170.43,18.34 0 top
R23830  10K  [0201]  170.43,18.95 0 top
R23831  10K  [0201]  170.43,19.56 0 top
R23832  10K  [0201]  170.43,20.17 0 top
R23833  10K  [0201]  170.43,20.78 0 top
R23834  10K  [0201]  170.43,21.39 0 top
R23835  10K  [0201]  170.43,22 0 top
R23836  10K  [0201]  170.43,22.61 0 top
R23837  10K  [0201]  170.43,23.22 0 top
R23838  10K  [0201]  170.43,23.83 0 top
R23839  10K  [0201]  170.43,24.43 0 top
R23840  10K  [0201]  170.43,25.04 0 top
R23841  10K  [0201]  170.43,25.65 0 top
R23842  10K  [0201]  170.43,26.26 0 top
R23843  10K  [0201]  170.43,26.87 0 top
R23844  10K  [0201]  170.43,27.48 0 top
R23845  10K  [0201]  170.43,28.09 0 top
R23846  10K  [0201]  170.43,28.7 0 top
R23847  10K  [0201]  170.43,29.31 0 top
R23848  10K  [0201]  170.43,29.92 0 top
R23849  10K  [0201]  170.43,30.53 0 top
R23850  10K  [0201]  170.43,31.14 0 top
R23851  10K  [0201]  170.43,31.75 0 top
R23852  10K  [0201]  170.43,32.36 0 top
R23853  10K  [0201]  170.43,32.97 0 top
R23854  10K  [0201]  170.43,33.58 0 top
R23855  10K  [0201]  170.43,34.19 0 top
R23856  10K  [0201]  170.43,34.8 0 top
R23857  10K  [0201]  170.43,35.41 0 top
R23858  10K  [0201]  170.43,36.02 0 top
R23859  10K  [0201]  170.43,36.63 0 top
R23860  10K  [0201]  170.43,37.24 0 top
R23861  10K  [0201]  170.43,37.85 0 top
R23862  10K  [0201]  170.43,38.46 0 top
R23863  10K  [0201]  170.43,39.07 0 top
R23864  10K  [0201]  170.43,39.67 0 top
R23865  10K  [0201]  170.43,40.28 0 top
R23866  10K  [0201]  170.43,40.89 0 top
R23867  10K  [0201]  170.43,41.5 0 top
R23868  10K  [0201]  170.43,42.11 0 top
R23869  10K  [0201]  170.43,42.72 0 top
R23870  10K  [0201]  170.43,43.33 0 top
R23871  10K  [0201]  170.43,43.94 0 top
R23872  10K  [0201]  170.43,44.55 0 top
R23873  10K  [0201]  170.43,45.16 0 top
R23874  10K  [0201]  170.43,45.77 0 top
R23875  10K  [0201]  170.43,46.38 0 top
R23876  10K  [0201]  170.43,46.99 0 top
R23877  10K  [0201]  170.43,47.6 0 top
R23878  10K  [0201]  170.43,48.21 0 top
R23879  10K  [0201]  170.43,48.82 0 top
R23880  10K  [0201]  170.43,49.43 0 top
R23881  10K  [0201]  170.43,50.04 0 top
R23882  10K  [0201]  170.43,50.65 0 top
R23883  10K  [0201]  170.43,51.26 0 top
R23884  10K  [0201]  170.43,51.87 0 top
R23885  10K  [0201]  170.43,52.48 0 top
R23886  10K  [0201]  170.43,53.09 0 top
R23887  10K  [0201]  170.43,53.7 0 top
R23888  10K  [0201]  170.43,54.31 0 top
R23889  10K  [0201]  170.43,54.91 0 top
R23890  10K  [0201]  170.43,55.52 0 top
R23891  10K  [0201]  170.43,56.13 0 top
R23892  10K  [0201]  170.43,56.74 0 top
R23893  10K  [0201]  170.43,57.35 0 top
R23894  10K  [0201]  170.43,57.96 0 top
R23895  10K  [0201]  170.43,58.57 0 top
R23896  10K  [0201]  170.43,59.18 0 top
R23897  10K  [0201]  170.43,59.79 0 top
R23898  10K  [0201]  170.43,60.4 0 top
R23899  10K  [0201]  170.43,61.01 0 top
R23900  10K  [0201]  170.43,61.62 0 top
R23901  10K  [0201]  170.43,62.23 0 top
R23902  10K  [0201]  170.43,62.84 0 top
R23903  10K  [0201]  170.43,63.45 0 top
R23904  10K  [0201]  170.43,64.06 0 top
R23905  10K  [0201]  170.43,64.67 0 top
R23906  10K  [0201]  170.43,65.28 0 top
R23907  10K  [0201]  170.43,65.89 0 top
R23908  10K  [0201]  170.43,66.5 0 top
R23909  10K  [0201]  170.43,67.11 0 top
R23910  10K  [0201]  170.43,67.72 0 top
R23911  10K  [0201]  170.43,68.33 0 top
R23912  10K  [0201]  170.43,68.94 0 top
R23913  10K  [0201]  170.43,69.55 0 top
R23914  10K  [0201]  170.43,70.15 0 top
R23915  10K  [0201]  170.43,70.76 0 top
R23916  10K  [0201]  170.43,71.37 0 top
R23917  10K  [0201]  170.43,71.98 0 top
R23918  10K  [0201]  170.43,72.59 0 top
R23919  10K  [0201]  170.43,73.2 0 top
R23920  10K  [0201]  170.43,73.81 0 top
R23921  10K  [0201]  170.43,74.42 0 top
R23922  10K  [0201]  170.43,75.03 0 top
R23923  10K  [0201]  170.43,75.64 0 top
R23924  10K  [0201]  170.43,76.25 0 top
R23925  10K  [0201]  170.43,76.86 0 top
R23926  10K  [0201]  170.43,77.47 0 top
R23927  10K  [0201]  170.43,78.08 0 top
R23928  10K  [0201]  170.43,78.69 0 top
R23929  10K  [0201]  170.43,79.3 0 top
R23930  10K  [0201]  170.43,79.91 0 top
R23931  10K  [0201]  170.43,80.52 0 top
R23932  10K  [0201]  170.43,81.13 0 top
R23933  10K  [0201]  170.43,81.74 0 top
R23934  10K  [0201]  170.43,82.35 0 top
R23935  10K  [0201]  170.43,82.96 0 top
R23936  10K  [0201]  170.43,83.57 0 top
R23937  10K  [0201]  170.43,84.18 0 top
R23938  10K  [0201]  170.43,84.79 0 top
R23939  10K  [0201]  170.43,85.39 0 top
R23940  10K  [0201]  170.43,86 0 top
R23941  10K  [0201]  170.43,86.61 0 top
R23942  10K  [0201]  170.43,87.22 0 top
R23943  10K  [0201]  170.43,87.83 0 top
R23944  10K  [0201]  170.43,88.44 0 top
R23945  10K  [0201]  170.43,89.05 0 top
R23946  10K  [0201]  170.43,89.66 0 top
R23947  10K  [0201]  170.43,90.27 0 top
R23948  10K  [0201]  170.43,90.88 0 top
R23949  10K  [0201]  170.43,91.49 0 top
R23950  10K  [0201]  170.43,92.1 0 top
R23951  10K  [0201]  170.43,92.71 0 top
R23952  10K  [0201]  170.43,93.32 0 top
R23953  10K  [0201]  170.43,93.93 0 top
R23954  10K  [0201]  170.43,94.54 0 top
R23955  10K  [0201]  170.43,95.15 0 top
R23956  10K  [0201]  170.43,95.76 0 top
R23957  10K  [0201]  170.43,96.37 0 top
R23958  10K  [0201]  170.43,96.98 0 top
R23959  10K  [0201]  170.43,97.59 0 top
R23960  10K  [0201]  170.43,98.2 0 top
R23961  10K  [0201]  170.43,98.81 0 top
R23962  10K  [0201]  170.43,99.42 0 top
R23963  10K  [0201]  170.43,100.03 0 top
R23964  10K  [0201]  170.43,100.63 0 top
R23965  10K  [0201]  170.43,101.24 0 top
R23966  10K  [0201]  170.43,101.85 0 top
R23967  10K  [0201]  170.43,102.46 0 top
R23968  10K  [0201]  170.43,103.07 0 top
R23969  10K  [0201]  170.43,103.68 0 top
R23970  10K  [0201]  170.43,104.29 0 top
R23971  10K  [0201]  170.43,104.9 0 top
R23972  10K  [0201]  170.43,105.51 0 top
R23973  10K  [0201]  170.43,106.12 0 top
R23974  10K  [0201]  170.43,106.73 0 top
R23975  10K  [0201]  170.43,107.34 0 top
R23976  10K  [0201]  170.43,107.95 0 top
R23977  10K  [0201]  170.43,108.56 0 top
R23978  10K  [0201]  170.43,109.17 0 top
R23979  10K  [0201]  170.43,109.78 0 top
R23980  10K  [0201]  170.43,110.39 0 top
R23981  10K  [0201]  170.43,111 0 top
R23982  10K  [0201]  170.43,111.61 0 top
R23983  10K  [0201]  170.43,112.22 0 top
R23984  10K  [0201]  170.43,112.83 0 top
R23985  10K  [0201]  170.43,113.44 0 top
R23986  10K  [0201]  170.43,114.05 0 top
R23987  10K  [0201]  170.43,114.66 0 top
R23988  10K  [0201]  170.43,115.27 0 top
R23989  10K  [0201]  170.43,115.87 0 top
R23990  10K  [0201]  170.43,116.48 0 top
R23991  10K  [0201]  170.43,117.09 0 top
R23992  10K  [0201]  170.43,117.7 0 top
R23993  10K  [0201]  170.43,118.31 0 top
R23994  10K  [0201]  170.43,118.92 0 top
R23995  10K  [0201]  170.43,119.53 0 top
R23996  10K  [0201]  170.43,120.14 0 top
R23997  10K  [0201]  170.43,120.75 0 top
R23998  10K  [0201]  170.43,121.36 0 top
R23999  10K  [0201]  170.43,121.97 0 top
R24000  10K  [0201]  170.43,122.58 0 top
R24001  10K  [0201]  171.65,1.27 0 top
R24002  10K  [0201]  171.65,1.88 0 top
R24003  10K  [0201]  171.65,2.49 0 top
R24004  10K  [0201]  171.65,3.1 0 top
R24005  10K  [0201]  171.65,3.71 0 top
R24006  10K  [0201]  171.65,4.32 0 top
R24007  10K  [0201]  171.65,4.93 0 top
R24008  10K  [0201]  171.65,5.54 0 top
R24009  10K  [0201]  171.65,6.15 0 top
R24010  10K  [0201]  171.65,6.76 0 top
R24011  10K  [0201]  171.65,7.37 0 top
R24012  10K  [0201]  171.65,7.98 0 top
R24013  10K  [0201]  171.65,8.59 0 top
R24014  10K  [0201]  171.65,9.19 0 top
R24015  10K  [0201]  171.65,9.8 0 top
R24016  10K  [0201]  171.65,10.41 0 top
R24017  10K  [0201]  171.65,11.02 0 top
R24018  10K  [0201]  171.65,11.63 0 top
R24019  10K  [0201]  171.65,12.24 0 top
R24020  10K  [0201]  171.65,12.85 0 top
R24021  10K  [0201]  171.65,13.46 0 top
R24022  10K  [0201]  171.65,14.07 0 top
R24023  10K  [0201]  171.65,14.68 0 top
R24024  10K  [0201]  171.65,15.29 0 top
R24025  10K  [0201]  171.65,15.9 0 top
R24026  10K  [0201]  171.65,16.51 0 top
R24027  10K  [0201]  171.65,17.12 0 top
R24028  10K  [0201]  171.65,17.73 0 top
R24029  10K  [0201]  171.65,18.34 0 top
R24030  10K  [0201]  171.65,18.95 0 top
R24031  10K  [0201]  171.65,19.56 0 top
R24032  10K  [0201]  171.65,20.17 0 top
R24033  10K  [0201]  171.65,20.78 0 top
R24034  10K  [0201]  171.65,21.39 0 top
R24035  10K  [0201]  171.65,22 0 top
R24036  10K  [0201]  171.65,22.61 0 top
R24037  10K  [0201]  171.65,23.22 0 top
R24038  10K  [0201]  171.65,23.83 0 top
R24039  10K  [0201]  171.65,24.43 0 top
R24040  10K  [0201]  171.65,25.04 0 top
R24041  10K  [0201]  171.65,25.65 0 top
R24042  10K  [0201]  171.65,26.26 0 top
R24043  10K  [0201]  171.65,26.87 0 top
R24044  10K  [0201]  171.65,27.48 0 top
R24045  10K  [0201]  171.65,28.09 0 top
R24046  10K  [0201]  171.65,28.7 0 top
R24047  10K  [0201]  171.65,29.31 0 top
R24048  10K  [0201]  171.65,29.92 0 top
R24049  10K  [0201]  171.65,30.53 0 top
R24050  10K  [0201]  171.65,31.14 0 top
R24051  10K  [0201]  171.65,31.75 0 top
R24052  10K  [0201]  171.65,32.36 0 top
R24053  10K  [0201]  171.65,32.97 0 top
R24054  10K  [0201]  171.65,33.58 0 top
R24055  10K  [0201]  171.65,34.19 0 top
R24056  10K  [0201]  171.65,34.8 0 top
R24057  10K  [0201]  171.65,35.41 0 top
R24058  10K  [0201]  171.65,36.02 0 top
R24059  10K  [0201]  171.65,36.63 0 top
R24060  10K  [0201]  171.65,37.24 0 top
R24061  10K  [0201]  171.65,37.85 0 top
R24062  10K  [0201]  171.65,38.46 0 top
R24063  10K  [0201]  171.65,39.07 0 top
R24064  10K  [0201]  171.65,39.67 0 top
R24065  10K  [0201]  171.65,40.28 0 top
R24066  10K  [0201]  171.65,40.89 0 top
R24067  10K  [0201]  171.65,41.5 0 top
R24068  10K  [0201]  171.65,42.11 0 top
R24069  10K  [0201]  171.65,42.72 0 top
R24070  10K  [0201]  171.65,43.33 0 top
R24071  10K  [0201]  171.65,43.94 0 top
R24072  10K  [0201]  171.65,44.55 0 top
R24073  10K  [0201]  171.65,45.16 0 top
R24074  10K  [0201]  171.65,45.77 0 top
R24075  10K  [0201]  171.65,46.38 0 top
R24076  10K  [0201]  171.65,46.99 0 top
R24077  10K  [0201]  171.65,47.6 0 top
R24078  10K  [0201]  171.65,48.21 0 top
R24079  10K  [0201]  171.65,48.82 0 top
R24080  10K  [0201]  171.65,49.43 0 top
R24081  10K  [0201]  171.65,50.04 0 top
R24082  10K  [0201]  171.65,50.65 0 top
R24083  10K  [0201]  171.65,51.26 0 top
R24084  10K  [0201]  171.65,51.87 0 top
R24085  10K  [0201]  171.65,52.48 0 top
R24086  10K  [0201]  171.65,53.09 0 top
R24087  10K  [0201]  171.65,53.7 0 top
R24088  10K  [0201]  171.65,54.31 0 top
R24089  10K  [0201]  171.65,54.91 0 top
R24090  10K  [0201]  171.65,55.52 0 top
R24091  10K  [0201]  171.65,56.13 0 top
R24092  10K  [0201]  171.65,56.74 0 top
R24093  10K  [0201]  171.65,57.35 0 top
R24094  10K  [0201]  171.65,57.96 0 top
R24095  10K  [0201]  171.65,58.57 0 top
R24096  10K  [0201]  171.65,59.18 0 top
R24097  10K  [0201]  171.65,59.79 0 top
R24098  10K  [0201]  171.65,60.4 0 top
R24099  10K  [0201]  171.65,61.01 0 top
R24100  10K  [0201]  171.65,61.62 0 top
R24101  10K  [0201]  171.65,62.23 0 top
R24102  10K  [0201]  171.65,62.84 0 top
R24103  10K  [0201]  171.65,63.45 0 top
R24104  10K  [0201]  171.65,64.06 0 top
R24105  10K  [0201]  171.65,64.67 0 top
R24106  10K  [0201]  171.65,65.28 0 top
R24107  10K  [0201]  171.65,65.89 0 top
R24108  10K  [0201]  171.65,66.5 0 top
R24109  10K  [0201]  171.65,67.11 0 top
R24110  10K  [0201]  171.65,67.72 0 top
R24111  10K  [0201]  171.65,68.33 0 top
R24112  10K  [0201]  171.65,68.94 0 top
R24113  10K  [0201]  171.65,69.55 0 top
R24114  10K  [0201]  171.65,70.15 0 top
R24115  10K  [0201]  171.65,70.76 0 top
R24116  10K  [0201]  171.65,71.37 0 top
R24117  10K  [0201]  171.65,71.98 0 top
R24118  10K  [0201]  171.65,72.59 0 top
R24119  10K  [0201]  171.65,73.2 0 top
R24120  10K  [0201]  171.65,73.81 0 top
R24121  10K  [0201]  171.65,74.42 0 top
R24122  10K  [0201]  171.65,75.03 0 top
R24123  10K  [0201]  171.65,75.64 0 top
R24124  10K  [0201]  171.65,76.25 0 top
R24125  10K  [0201]  171.65,76.86 0 top
R24126  10K  [0201]  171.65,77.47 0 top
R24127  10K  [0201]  171.65,78.08 0 top
R24128  10K  [0201]  171.65,78.69 0 top
R24129  10K  [0201]  171.65,79.3 0 top
R24130  10K  [0201]  171.65,79.91 0 top
R24131  10K  [0201]  171.65,80.52 0 top
R24132  10K  [0201]  171.65,81.13 0 top
R24133  10K  [0201]  171.65,81.74 0 top
R24134  10K  [0201]  171.65,82.35 0 top
R24135  10K  [0201]  171.65,82.96 0 top
R24136  10K  [0201]  171.65,83.57 0 top
R24137  10K  [0201]  171.65,84.18 0 top
R24138  10K  [0201]  171.65,84.79 0 top
R24139  10K  [0201]  171.65,85.39 0 top
R24140  10K  [0201]  171.65,86 0 top
R24141  10K  [0201]  171.65,86.61 0 top
R24142  10K  [0201]  171.65,87.22 0 top
R24143  10K  [0201]  171.65,87.83 0 top
R24144  10K  [0201]  171.65,88.44 0 top
R24145  10K  [0201]  171.65,89.05 0 top
R24146  10K  [0201]  171.65,89.66 0 top
R24147  10K  [0201]  171.65,90.27 0 top
R24148  10K  [0201]  171.65,90.88 0 top
R24149  10K  [0201]  171.65,91.49 0 top
R24150  10K  [0201]  171.65,92.1 0 top
R24151  10K  [0201]  171.65,92.71 0 top
R24152  10K  [0201]  171.65,93.32 0 top
R24153  10K  [0201]  171.65,93.93 0 top
R24154  10K  [0201]  171.65,94.54 0 top
R24155  10K  [0201]  171.65,95.15 0 top
R24156  10K  [0201]  171.65,95.76 0 top
R24157  10K  [0201]  171.65,96.37 0 top
R24158  10K  [0201]  171.65,96.98 0 top
R24159  10K  [0201]  171.65,97.59 0 top
R24160  10K  [0201]  171.65,98.2 0 top
R24161  10K  [0201]  171.65,98.81 0 top
R24162  10K  [0201]  171.65,99.42 0 top
R24163  10K  [0201]  171.65,100.03 0 top
R24164  10K  [0201]  171.65,100.63 0 top
R24165  10K  [0201]  171.65,101.24 0 top
R24166  10K  [0201]  171.65,101.85 0 top
R24167  10K  [0201]  171.65,102.46 0 top
R24168  10K  [0201]  171.65,103.07 0 top
R24169  10K  [0201]  171.65,103.68 0 top
R24170  10K  [0201]  171.65,104.29 0 top
R24171  10K  [0201]  171.65,104.9 0 top
R24172  10K  [0201]  171.65,105.51 0 top
R24173  10K  [0201]  171.65,106.12 0 top
R24174  10K  [0201]  171.65,106.73 0 top
R24175  10K  [0201]  171.65,107.34 0 top
R24176  10K  [0201]  171.65,107.95 0 top
R24177  10K  [0201]  171.65,108.56 0 top
R24178  10K  [0201]  171.65,109.17 0 top
R24179  10K  [0201]  171.65,109.78 0 top
R24180  10K  [0201]  171.65,110.39 0 top
R24181  10K  [0201]  171.65,111 0 top
R24182  10K  [0201]  171.65,111.61 0 top
R24183  10K  [0201]  171.65,112.22 0 top
R24184  10K  [0201]  171.65,112.83 0 top
R24185  10K  [0201]  171.65,113.44 0 top
R24186  10K  [0201]  171.65,114.05 0 top
R24187  10K  [0201]  171.65,114.66 0 top
R24188  10K  [0201]  171.65,115.27 0 top
R24189  10K  [0201]  171.65,115.87 0 top
R24190  10K  [0201]  171.65,116.48 0 top
R24191  10K  [0201]  171.65,117.09 0 top
R24192  10K  [0201]  171.65,117.7 0 top
R24193  10K  [0201]  171.65,118.31 0 top
R24194  10K  [0201]  171.65,118.92 0 top
R24195  10K  [0201]  171.65,119.53 0 top
R24196  10K  [0201]  171.65,120.14 0 top
R24197  10K  [0201]  171.65,120.75 0 top
R24198  10K  [0201]  171.65,121.36 0 top
R24199  10K  [0201]  171.65,121.97 0 top
R24200  10K  [0201]  171.65,122.58 0 top
R24201  10K  [0201]  172.87,1.27 0 top
R24202  10K  [0201]  172.87,1.88 0 top
R24203  10K  [0201]  172.87,2.49 0 top
R24204  10K  [0201]  172.87,3.1 0 top
R24205  10K  [0201]  172.87,3.71 0 top
R24206  10K  [0201]  172.87,4.32 0 top
R24207  10K  [0201]  172.87,4.93 0 top
R24208  10K  [0201]  172.87,5.54 0 top
R24209  10K  [0201]  172.87,6.15 0 top
R24210  10K  [0201]  172.87,6.76 0 top
R24211  10K  [0201]  172.87,7.37 0 top
R24212  10K  [0201]  172.87,7.98 0 top
R24213  10K  [0201]  172.87,8.59 0 top
R24214  10K  [0201]  172.87,9.19 0 top
R24215  10K  [0201]  172.87,9.8 0 top
R24216  10K  [0201]  172.87,10.41 0 top
R24217  10K  [0201]  172.87,11.02 0 top
R24218  10K  [0201]  172.87,11.63 0 top
R24219  10K  [0201]  172.87,12.24 0 top
R24220  10K  [0201]  172.87,12.85 0 top
R24221  10K  [0201]  172.87,13.46 0 top
R24222  10K  [0201]  172.87,14.07 0 top
R24223  10K  [0201]  172.87,14.68 0 top
R24224  10K  [0201]  172.87,15.29 0 top
R24225  10K  [0201]  172.87,15.9 0 top
R24226  10K  [0201]  172.87,16.51 0 top
R24227  10K  [0201]  172.87,17.12 0 top
R24228  10K  [0201]  172.87,17.73 0 top
R24229  10K  [0201]  172.87,18.34 0 top
R24230  10K  [0201]  172.87,18.95 0 top
R24231  10K  [0201]  172.87,19.56 0 top
R24232  10K  [0201]  172.87,20.17 0 top
R24233  10K  [0201]  172.87,20.78 0 top